# EAGLE board Copypaste (EAGLE 7.6.0), part 1 of 2
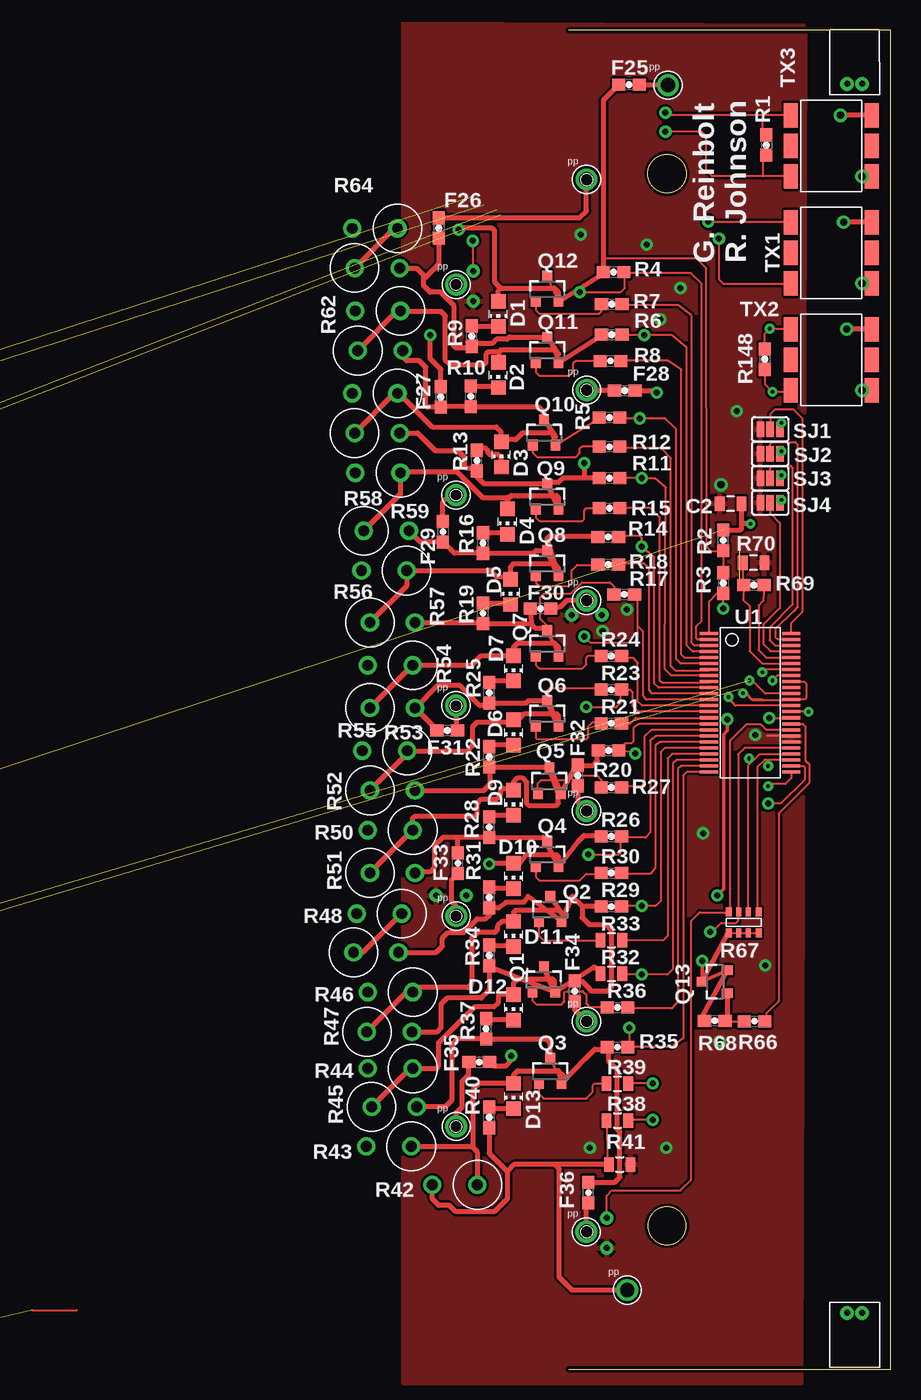
[diagram p3: board, top side]
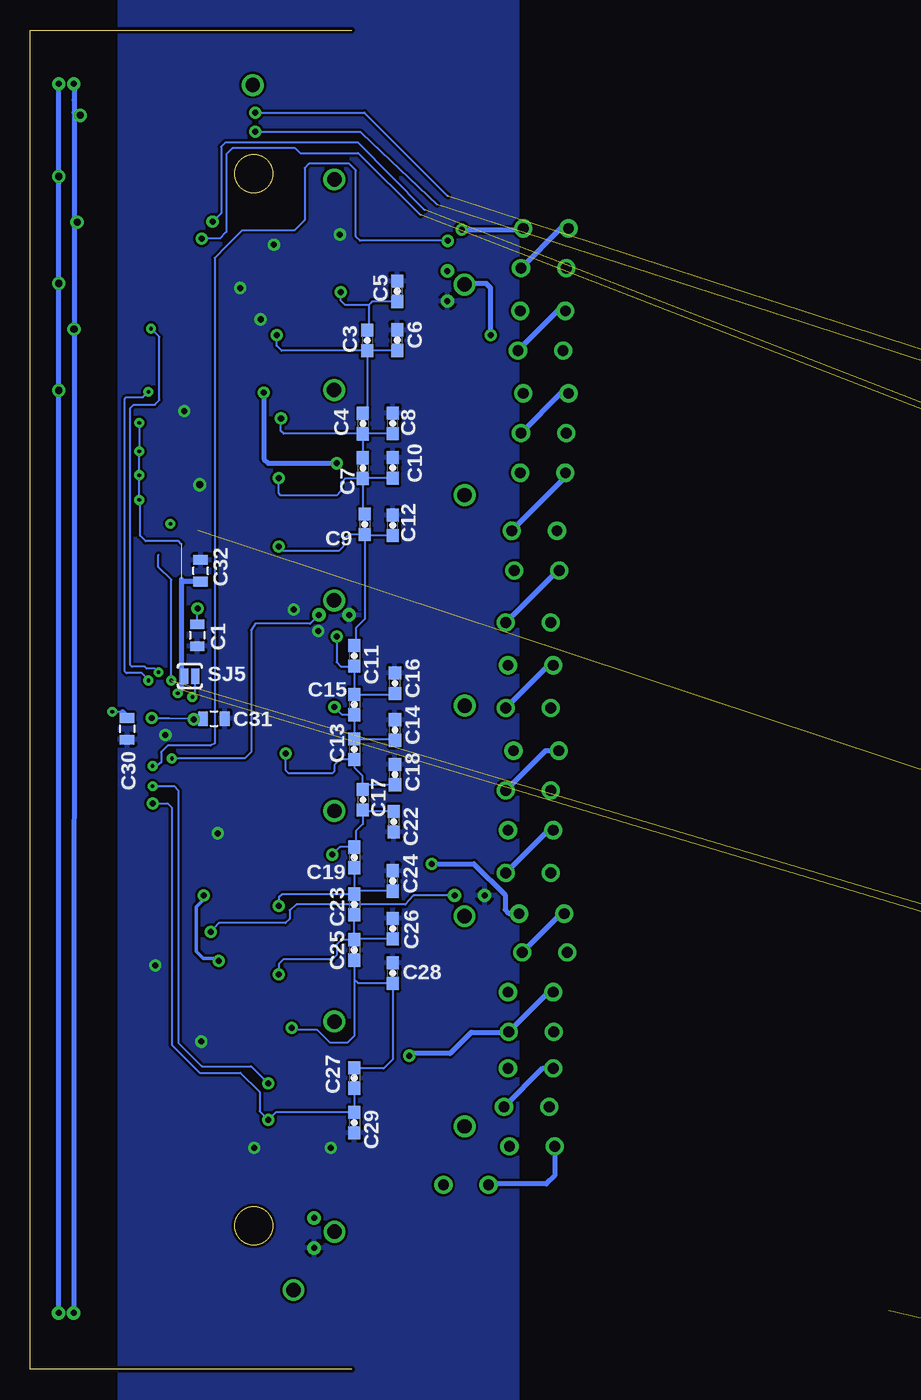
[diagram p4: board, bottom side, seen from below]

Size 26.75 x 111.35 mm. Coordinates in mm from the lower left corner, seen from the top.
Outline: 0,0 26.75,0 26.75,111.35 0,111.35
Outline: circle at 8.15,99.42 radius 1.6
Outline: circle at 8.15,11.94 radius 1.57
Copper layers (1*16): Top 0.035mm / dielectric 1.5mm / Bottom 0.035mm
Design rules "SparkFun *": minimum track width 7mil, minimum drill 12mil, track to track 8mil, track to pad 8mil, pad to pad 8mil, via to via 8mil, smd to smd 8mil, copper to edge 10mil, drill to drill 8mil, minimum pad ring 12mil, minimum via ring 10mil, stop-mask expansion 4mil, vias tented up to drill 25mil, thermal gap 10mil

## Footprints (pad centres in the part's own frame; a part is rotated, then mirrored left to right if it is on the bottom)
0805 = smd 0.8 x 1.2: 1 -0.9,0; 2 0.9,0
0603 = smd 1.1 x 1: 1 -0.85,0; 2 0.85,0
CHIP_LED0805 = smd 1.2 x 1.2: A 0,-1.05; C 0,1.05
DF13-2P = drill 0.5: 1 -0.625,0; 2 0.625,0
SOT23 = smd 0.8 x 0.9: 1 -0.95,-1; 2 0.95,-1; 3 0,1.1
RR02J16RTB = drill 0.9: P$1 -3.75,0; P$2 0,0
MNR14 = smd 0.5 x 0.75: 1 -1.25,-0.9; 4 1.25,-0.9; 5 1.25,0.85; 8 -1.25,0.85 | smd 0.4 x 0.75: 2 -0.4,-0.9; 3 0.4,-0.9; 6 0.4,0.85; 7 -0.4,0.85
NTC-NXRT15XH103FA5B = drill 0.5: P$1 0,0; P$2 2.5,0
PAD-JUMPER-3-NO_YES_SILK = smd 0.635 x 1.27: 1 -0.813,0; 2 0,0; 3 0.813,0
PAD-JUMPER-2-NO_YES_SILK = smd 0.635 x 1.27: 1 -0.45,0; 2 0.45,0
PE-68386NLT = smd 1.143 x 2.032: 1 -3.378,2.54; 2 -3.378,0; 3 -3.378,-2.54; 4 3.353,-2.54; 5 3.353,0; 6 3.353,2.54
SSOP-48 = smd 0.25 x 1.524: 1 -5.75,-3.421; 2 -5.25,-3.421; 3 -4.75,-3.421; 4 -4.25,-3.421; 5 -3.75,-3.421; 6 -3.25,-3.421; 7 -2.75,-3.421; 8 -2.25,-3.421; 9 -1.75,-3.421; 10 -1.25,-3.421; 11 -0.75,-3.421; 12 -0.25,-3.421; 13 0.25,-3.421; 14 0.75,-3.421; 15 1.25,-3.421; 16 1.75,-3.421; 17 2.25,-3.421; 18 2.75,-3.421; 19 3.25,-3.421; 20 3.75,-3.421; 21 4.25,-3.421; 22 4.75,-3.421; 23 5.25,-3.421; 24 5.75,-3.421; 25 5.75,3.421; 26 5.25,3.421; 27 4.75,3.421; 28 4.25,3.421; 29 3.75,3.421; 30 3.25,3.421; 31 2.75,3.421; 32 2.25,3.421; 33 1.75,3.421; 34 1.25,3.421; 35 0.75,3.421; 36 0.25,3.421; 37 -0.25,3.421; 38 -0.75,3.421; 39 -1.25,3.421; 40 -1.75,3.421; 41 -2.25,3.421; 42 -2.75,3.421; 43 -3.25,3.421; 44 -3.75,3.421; 45 -4.25,3.421; 46 -4.75,3.421; 47 -5.25,3.421; 48 -5.75,3.421
POGOPIN = drill 1.2: 1 0,0
SOT223 = smd 1.5 x 2: P$1 0,0; P$2 2.3,0; P$3 4.6,0 | smd 3.8 x 2: P$4 2.2,6.3

## Placement (x,y rotation side)
C1  0.1UF  [0805]  12.85,61.04 270 bottom
C2  0.1UF  [0805]  13.44,71.98 180 top
C3  10NF  [0603]  -1.27,85.55 270 bottom
C4  10NF  [0603]  -0.91,78.64 270 bottom
C5  DNP  [0603]  -3.76,89.64 90 bottom  (outside the outline)
C6  DNP  [0603]  -3.76,85.57 90 bottom  (outside the outline)
C7  10NF  [0603]  -0.91,74.93 270 bottom
C8  DNP  [0603]  -3.4,78.66 90 bottom  (outside the outline)
C9  10NF  [0603]  -1.07,70.26 270 bottom
C10  DNP  [0603]  -3.4,74.96 90 bottom  (outside the outline)
C11  10NF  [0603]  -0.2,59.33 270 bottom
C12  DNP  [0603]  -3.4,70.18 90 bottom  (outside the outline)
C13  10NF  [0603]  -0.2,51.56 270 bottom
C14  DNP  [0603]  -3.58,53.16 90 bottom  (outside the outline)
C15  10NF  [0603]  -0.2,55.27 270 bottom
C16  DNP  [0603]  -3.58,57.05 90 bottom  (outside the outline)
C17  10NF  [0603]  -0.91,47.37 270 bottom
C18  DNP  [0603]  -3.58,49.45 90 bottom  (outside the outline)
C19  10NF  [0603]  -0.2,42.57 270 bottom
C20  0.1UF  [0805]  -278.31,-0.51 0 top  (outside the outline)
C21  0.1UF  [0805]  -270.08,1.83 0 top  (outside the outline)
C22  DNP  [0603]  -3.48,45.54 270 bottom  (outside the outline)
C23  10NF  [0603]  -0.2,38.66 270 bottom
C24  DNP  [0603]  -3.4,40.61 90 bottom  (outside the outline)
C25  10NF  [0603]  -0.2,34.87 270 bottom
C26  DNP  [0603]  -3.4,36.65 90 bottom  (outside the outline)
C27  10NF  [0603]  -0.2,24.23 270 bottom
C28  DNP  [0603]  -3.4,32.94 90 bottom  (outside the outline)
C29  10NF  [0603]  -0.2,20.52 270 bottom
C30  1UF  [0805]  18.68,53.26 270 bottom
C31  1UF  [0805]  11.47,54.11 0 bottom
C32  1UF  [0805]  12.57,66.4 90 bottom
C33  10NF  [0603]  -294.23,20.62 270 bottom  (outside the outline)
C34  10NF  [0603]  -294.23,16.56 270 bottom  (outside the outline)
C37  10NF  [0603]  -294.23,12.5 270 bottom  (outside the outline)
C39  10NF  [0603]  -293.52,2.03 270 bottom  (outside the outline)
C41  10NF  [0603]  -293.52,-1.78 270 bottom  (outside the outline)
C43  10NF  [0603]  -293.34,-15.65 270 bottom  (outside the outline)
C45  10NF  [0603]  -293.52,-5.59 270 bottom  (outside the outline)
C47  10NF  [0603]  -293.34,-19.91 270 bottom  (outside the outline)
C49  10NF  [0603]  -293.34,-23.72 270 bottom  (outside the outline)
C51  10NF  [0603]  -293.34,-27.99 270 bottom  (outside the outline)
C53  10NF  [0603]  -293.34,-31.9 270 bottom  (outside the outline)
C55  10NF  [0603]  -293.88,-38.91 270 bottom  (outside the outline)
C57  10NF  [0603]  -293.79,-42.8 270 bottom  (outside the outline)
C58  1UF  [0805]  -268.78,-11.86 0 top  (outside the outline)
C59  1UF  [0805]  -277.75,-11.76 270 bottom  (outside the outline)
C60  1UF  [0805]  -268.43,-4.85 0 top  (outside the outline)
C61  1UF  [0805]  -268.44,-7.79 0 top  (outside the outline)
C63  0.1UF  [0805]  -332.71,18.52 90 top  (outside the outline)
C64  0.1UF  [0805]  -332.69,22.02 270 top  (outside the outline)
C65  10NF  [0603]  -355.09,20.14 270 bottom  (outside the outline)
C66  10NF  [0603]  -355.02,15.49 270 bottom  (outside the outline)
C69  10NF  [0603]  -354.89,11.25 270 bottom  (outside the outline)
C71  10NF  [0603]  -355.02,2.11 270 bottom  (outside the outline)
C73  10NF  [0603]  -355.14,-2.08 270 bottom  (outside the outline)
C75  10NF  [0603]  -355.27,-15.16 270 bottom  (outside the outline)
C77  10NF  [0603]  -355.27,-6.78 270 bottom  (outside the outline)
C79  10NF  [0603]  -355.37,-19.05 270 bottom  (outside the outline)
C81  10NF  [0603]  -355.37,-24.13 270 bottom  (outside the outline)
C83  10NF  [0603]  -355.37,-30.23 270 bottom  (outside the outline)
C85  10NF  [0603]  -355.37,-36.83 270 bottom  (outside the outline)
C87  10NF  [0603]  -355.22,-42.09 270 bottom  (outside the outline)
C89  10NF  [0603]  -342.16,-52.58 0 top  (outside the outline)
C90  1UF  [0805]  -323.98,-7.63 0 top  (outside the outline)
C91  1UF  [0805]  -324.13,-9.83 0 top  (outside the outline)
C92  1UF  [0805]  -321.72,-6.27 270 top  (outside the outline)
C93  1UF  [0805]  -331.83,26.78 180 top  (outside the outline)
D1  LED_RED  [CHIP_LED0805]  -5.87,87.76 180 top  (outside the outline)
D2  LED_RED  [CHIP_LED0805]  -5.87,82.68 180 top  (outside the outline)
D3  LED_RED  [CHIP_LED0805]  -5.61,76.07 180 top  (outside the outline)
D4  LED_RED  [CHIP_LED0805]  -5.11,70.48 180 top  (outside the outline)
D5  LED_RED  [CHIP_LED0805]  -4.85,64.64 180 top  (outside the outline)
D6  LED_RED  [CHIP_LED0805]  -4.6,52.96 180 top  (outside the outline)
D7  LED_RED  [CHIP_LED0805]  -4.6,58.29 180 top  (outside the outline)
D8  LED_RED  [CHIP_LED0805]  -304.39,30.05 180 top  (outside the outline)
D9  LED_RED  [CHIP_LED0805]  -4.6,47.12 180 top  (outside the outline)
D10  LED_RED  [CHIP_LED0805]  -4.6,41.02 180 top  (outside the outline)
D11  LED_RED  [CHIP_LED0805]  -4.6,36.2 180 top  (outside the outline)
D12  LED_RED  [CHIP_LED0805]  -4.6,30.1 180 top  (outside the outline)
D13  LED_RED  [CHIP_LED0805]  -4.6,22.73 180 top  (outside the outline)
D14  LED_RED  [CHIP_LED0805]  -304.32,23.37 180 top  (outside the outline)
D15  LED_RED  [CHIP_LED0805]  -304.06,13.72 180 top  (outside the outline)
D16  LED_RED  [CHIP_LED0805]  -304.06,9.65 180 top  (outside the outline)
D17  LED_RED  [CHIP_LED0805]  -304.06,3.3 180 top  (outside the outline)
D18  LED_RED  [CHIP_LED0805]  -303.81,-11.18 180 top  (outside the outline)
D19  LED_RED  [CHIP_LED0805]  -303.81,-4.06 180 top  (outside the outline)
D20  LED_RED  [CHIP_LED0805]  -302.79,-18.54 180 top  (outside the outline)
D21  LED_RED  [CHIP_LED0805]  -304.32,-25.4 180 top  (outside the outline)
D22  LED_RED  [CHIP_LED0805]  -304.32,-30.99 180 top  (outside the outline)
D23  LED_RED  [CHIP_LED0805]  -304.32,-39.88 180 top  (outside the outline)
D24  LED_RED  [CHIP_LED0805]  -304.32,-46.74 180 top  (outside the outline)
D25  LED_RED  [CHIP_LED0805]  -364.01,29.72 180 top  (outside the outline)
D26  LED_RED  [CHIP_LED0805]  -364.01,23.11 180 top  (outside the outline)
D27  LED_RED  [CHIP_LED0805]  -364.01,16.51 180 top  (outside the outline)
D28  LED_RED  [CHIP_LED0805]  -364.01,9.91 180 top  (outside the outline)
D29  LED_RED  [CHIP_LED0805]  -364.01,3.81 180 top  (outside the outline)
D30  LED_RED  [CHIP_LED0805]  -364.01,-9.4 180 top  (outside the outline)
D31  LED_RED  [CHIP_LED0805]  -364.01,-2.79 180 top  (outside the outline)
D32  LED_RED  [CHIP_LED0805]  -364.01,-16 180 top  (outside the outline)
D33  LED_RED  [CHIP_LED0805]  -364.01,-22.61 180 top  (outside the outline)
D34  LED_RED  [CHIP_LED0805]  -364.01,-29.21 180 top  (outside the outline)
D35  LED_RED  [CHIP_LED0805]  -364.01,-35.81 180 top  (outside the outline)
D36  LED_RED  [CHIP_LED0805]  -364.01,-42.42 180 top  (outside the outline)
F1  FUSE_750MA_63V_0603  [0603]  -344.25,41.86 180 top  (outside the outline)
F2  FUSE_750MA_63V_0603  [0603]  -355.88,27.18 180 top  (outside the outline)
F3  FUSE_750MA_63V_0603  [0603]  -355.88,20.57 180 top  (outside the outline)
F4  FUSE_750MA_63V_0603  [0603]  -355.88,13.46 180 top  (outside the outline)
F5  FUSE_750MA_63V_0603  [0603]  -355.88,7.87 180 top  (outside the outline)
F6  FUSE_750MA_63V_0603  [0603]  -355.88,0.76 180 top  (outside the outline)
F7  FUSE_750MA_63V_0603  [0603]  -355.88,-11.43 180 top  (outside the outline)
F8  FUSE_750MA_63V_0603  [0603]  -355.88,-18.03 180 top  (outside the outline)
F9  FUSE_750MA_63V_0603  [0603]  -355.88,-24.64 180 top  (outside the outline)
F10  FUSE_750MA_63V_0603  [0603]  -355.88,-31.24 180 top  (outside the outline)
F11  FUSE_750MA_63V_0603  [0603]  -355.88,-37.85 180 top  (outside the outline)
F12  FUSE_750MA_63V_0603  [0603]  -355.88,-44.45 180 top  (outside the outline)
F13  FUSE_750MA_63V_0603  [0603]  -297.97,40.89 270 top  (outside the outline)
F14  FUSE_750MA_63V_0603  [0603]  -301.52,34.34 0 top  (outside the outline)
F15  FUSE_750MA_63V_0603  [0603]  -300.36,21.06 180 top  (outside the outline)
F16  FUSE_750MA_63V_0603  [0603]  -301.85,18.01 0 top  (outside the outline)
F17  FUSE_750MA_63V_0603  [0603]  -298.15,7.24 180 top  (outside the outline)
F18  FUSE_750MA_63V_0603  [0603]  -301.4,-0.58 0 top  (outside the outline)
F19  FUSE_750MA_63V_0603  [0603]  -297.46,-8.89 180 top  (outside the outline)
F20  FUSE_750MA_63V_0603  [0603]  -302.77,-15.67 0 top  (outside the outline)
F21  FUSE_750MA_63V_0603  [0603]  -297.15,-27.61 180 top  (outside the outline)
F22  FUSE_750MA_63V_0603  [0603]  -301.93,-35.46 0 top  (outside the outline)
F23  FUSE_750MA_63V_0603  [0603]  -298.25,-42.55 180 top  (outside the outline)
F24  FUSE_750MA_63V_0603  [0603]  -300.51,-52.65 90 top  (outside the outline)
F25  FUSE_750MA_63V_0603  [0603]  5,106.81 180 top
F26  FUSE_750MA_63V_0603  [0603]  -10.82,94.89 270 top  (outside the outline)
F27  FUSE_750MA_63V_0603  [0603]  -10.64,80.85 270 top  (outside the outline)
F28  FUSE_750MA_63V_0603  [0603]  4.65,81.38 0 top
F29  FUSE_750MA_63V_0603  [0603]  -10.46,69.65 270 top  (outside the outline)
F30  FUSE_750MA_63V_0603  [0603]  -2.36,63.27 180 top
F31  FUSE_750MA_63V_0603  [0603]  -10.11,53.11 180 top  (outside the outline)
F32  FUSE_750MA_63V_0603  [0603]  0.74,49.38 90 top
F33  FUSE_750MA_63V_0603  [0603]  -9.22,42.09 90 top  (outside the outline)
F34  FUSE_750MA_63V_0603  [0603]  0.48,31.45 90 top
F35  FUSE_750MA_63V_0603  [0603]  -7.44,25.55 0 top  (outside the outline)
F36  FUSE_750MA_63V_0603  [0603]  1.63,14.71 90 top
J1  M2_DF13-2P  [DF13-2P]  23.75,4.7 180 top
J2  M2_DF13-2P  [DF13-2P]  23.74,106.88 0 top
Q1  BSS308PE  [SOT23]  -2.08,32.39 0 top
Q2  BSS308PE  [SOT23]  -1.55,38.23 0 top
Q3  BSS308PE  [SOT23]  -1.55,24.76 0 top
Q4  BSS308PE  [SOT23]  -1.8,42.8 0 top
Q5  BSS308PE  [SOT23]  -1.63,48.89 0 top
Q6  BSS308PE  [SOT23]  -1.8,54.48 0 top
Q7  BSS308PE  [SOT23]  -1.8,60.33 0 top
Q8  BSS308PE  [SOT23]  -1.8,66.98 0 top
Q9  BSS308PE  [SOT23]  -1.8,72.52 0 top
Q10  BSS308PE  [SOT23]  -2.06,77.85 0 top
Q11  BSS308PE  [SOT23]  -1.8,84.71 0 top
Q12  BSS308PE  [SOT23]  -1.8,89.79 0 top
Q13  BSS308PE  [SOT23]  12.16,32.23 90 top
Q14  BSS308PE  [SOT23]  -359.94,-34.8 90 top  (outside the outline)
Q15  BSS308PE  [SOT23]  -359.94,-28.19 90 top  (outside the outline)
Q16  BSS308PE  [SOT23]  -359.94,-41.4 90 top  (outside the outline)
Q17  BSS308PE  [SOT23]  -359.94,-21.59 90 top  (outside the outline)
Q18  BSS308PE  [SOT23]  -359.94,-14.99 90 top  (outside the outline)
Q19  BSS308PE  [SOT23]  -359.94,-8.38 90 top  (outside the outline)
Q20  BSS308PE  [SOT23]  -359.94,-1.78 90 top  (outside the outline)
Q21  BSS308PE  [SOT23]  -359.94,4.83 90 top  (outside the outline)
Q22  BSS308PE  [SOT23]  -359.94,10.92 90 top  (outside the outline)
Q23  BSS308PE  [SOT23]  -359.94,17.53 90 top  (outside the outline)
Q24  BSS308PE  [SOT23]  -359.94,24.13 90 top  (outside the outline)
Q25  BSS308PE  [SOT23]  -359.94,30.73 90 top  (outside the outline)
Q26  BSS308PE  [SOT23]  -330.46,-24.9 180 top  (outside the outline)
Q27  BSS308PE  [SOT23]  -299.24,-38.86 90 top  (outside the outline)
Q28  BSS308PE  [SOT23]  -299.39,-30.12 90 top  (outside the outline)
Q29  BSS308PE  [SOT23]  -299.36,-45.69 90 top  (outside the outline)
Q30  BSS308PE  [SOT23]  -299.75,-24.13 90 top  (outside the outline)
Q31  BSS308PE  [SOT23]  -299.49,-18.29 90 top  (outside the outline)
Q32  BSS308PE  [SOT23]  -299.49,-11.94 90 top  (outside the outline)
Q33  BSS308PE  [SOT23]  -299.19,-3.33 90 top  (outside the outline)
Q34  BSS308PE  [SOT23]  -299.49,4.32 90 top  (outside the outline)
Q35  BSS308PE  [SOT23]  -299.75,10.92 90 top  (outside the outline)
Q36  BSS308PE  [SOT23]  -300,15.75 90 top  (outside the outline)
Q37  BSS308PE  [SOT23]  -300.51,24.38 90 top  (outside the outline)
Q38  BSS308PE  [SOT23]  -300.51,31.24 90 top  (outside the outline)
Q39  BSS308PE  [SOT23]  -273.75,-31.66 90 top  (outside the outline)
R1  DNP  [0603]  16.41,101.79 270 top
R2  100  [0603]  12.83,68.94 90 top
R3  100  [0603]  12.83,65.38 270 top
R4  100  [0603]  3.71,91.24 0 top
R5  100  [0603]  3.38,79.15 0 top
R6  100  [0603]  3.56,86.03 0 top
R7  3.3K  [0603]  3.56,88.57 0 top
R8  3.3K  [0603]  3.45,83.85 0 top
R9  475  [0603]  -8.08,85.9 90 top  (outside the outline)
R10  475  [0603]  -8.15,80.9 90 top  (outside the outline)
R11  100  [0603]  3.38,74.12 0 top
R12  3.3K  [0603]  3.38,76.71 0 top
R13  475  [0603]  -7.65,75.56 90 top  (outside the outline)
R14  100  [0603]  3.28,69.22 0 top
R15  3.3K  [0603]  3.38,71.6 0 top
R16  475  [0603]  -7.14,68.71 90 top  (outside the outline)
R17  100  [0603]  4.6,64.44 0 top
R18  3.3K  [0603]  3.28,66.93 0 top
R19  475  [0603]  -7.14,62.87 90 top  (outside the outline)
R20  100  [0603]  3.3,51.46 0 top
R21  3.3K  [0603]  3.53,53.72 0 top
R22  475  [0603]  -6.63,50.93 90 top  (outside the outline)
R23  100  [0603]  3.53,56.52 0 top
R24  3.3K  [0603]  3.53,59.31 0 top
R25  475  [0603]  -6.63,56.26 90 top  (outside the outline)
R26  100  [0603]  3.53,44.32 0 top
R27  3.3K  [0603]  3.53,48.39 0 top
R28  475  [0603]  -6.63,45.08 90 top  (outside the outline)
R29  100  [0603]  3.53,38.48 0 top
R30  3.3K  [0603]  3.53,41.28 0 top
R31  475  [0603]  -6.63,39.24 90 top  (outside the outline)
R32  100  [0805]  3.53,32.89 0 top
R33  3.3K  [0805]  3.53,35.69 0 top
R34  475  [0603]  -6.63,34.42 90 top  (outside the outline)
R35  100  [0603]  4.04,26.8 0 top
R36  3.3K  [0603]  4.04,30.1 0 top
R37  475  [0603]  -6.88,28.32 90 top  (outside the outline)
R38  100  [0805]  4.04,20.7 0 top
R39  3.3K  [0805]  4.04,23.75 0 top
R40  475  [0603]  -6.63,20.96 90 top  (outside the outline)
R41  0  [0805]  4.22,17.04 0 top
R42  16  [RR02J16RTB]  -7.61,15.35 0 top  (outside the outline)
R43  16  [RR02J16RTB]  -13.1,18.55 0 top  (outside the outline)
R44  16  [RR02J16RTB]  -12.98,25.02 0 top  (outside the outline)
R45  16  [RR02J16RTB]  -16.39,21.83 180 top  (outside the outline)
R46  16  [RR02J16RTB]  -12.98,31.37 0 top  (outside the outline)
R47  16  [RR02J16RTB]  -16.79,28.07 180 top  (outside the outline)
R48  16  [RR02J16RTB]  -13.89,37.9 0 top  (outside the outline)
R49  16  [RR02J16RTB]  -17.91,34.67 180 top  (outside the outline)
R50  16  [RR02J16RTB]  -12.98,44.83 0 top  (outside the outline)
R51  16  [RR02J16RTB]  -16.54,41.28 180 top  (outside the outline)
R52  16  [RR02J16RTB]  -16.54,48.13 180 top  (outside the outline)
R53  16  [RR02J16RTB]  -13.44,51.44 0 top  (outside the outline)
R54  16  [RR02J16RTB]  -12.98,58.55 0 top  (outside the outline)
R55  16  [RR02J16RTB]  -16.54,54.99 180 top  (outside the outline)
R56  16  [RR02J16RTB]  -13.49,66.42 0 top  (outside the outline)
R57  16  [RR02J16RTB]  -16.54,62.1 180 top  (outside the outline)
R58  16  [RR02J16RTB]  -14,74.55 0 top  (outside the outline)
R59  16  [RR02J16RTB]  -17.04,69.72 180 top  (outside the outline)
R60  16  [RR02J16RTB]  -14.25,81.15 0 top  (outside the outline)
R61  16  [RR02J16RTB]  -17.81,77.85 180 top  (outside the outline)
R62  16  [RR02J16RTB]  -14,88.01 0 top  (outside the outline)
R63  16  [RR02J16RTB]  -17.55,84.71 180 top  (outside the outline)
R64  16  [RR02J16RTB]  -14.25,94.87 0 top  (outside the outline)
R65  16  [RR02J16RTB]  -17.81,91.57 180 top  (outside the outline)
R66  1K  [0603]  15.42,28.96 0 top
R67  10K  [MNR14]  14.52,37.13 180 top
R68  100K  [0603]  12.12,28.99 180 top
R69  1.2K  [0603]  15.37,65.21 0 top
R70  787  [0805]  15.35,67.07 180 top
R71  10K-NTC  [NTC-NXRT15XH103FA5B]  -7.94,88.82 90 top  (outside the outline)
R72  10K-NTC  [NTC-NXRT15XH103FA5B]  0.24,62.74 0 top
R73  10K-NTC  [NTC-NXRT15XH103FA5B]  -11.03,39.4 0 top  (outside the outline)
R74  100  [0603]  -274.5,1.91 0 top  (outside the outline)
R75  100  [0805]  -278.31,1.91 180 top  (outside the outline)
R76  100  [0805]  -296.44,32.26 0 top  (outside the outline)
R77  100  [0603]  -296.19,16.51 0 top  (outside the outline)
R78  100  [0603]  -295.94,23.11 0 top  (outside the outline)
R79  3.3K  [0805]  -296.44,30.23 0 top  (outside the outline)
R80  3.3K  [0603]  -295.94,21.59 0 top  (outside the outline)
R81  475  [0603]  -306.4,28.19 90 top  (outside the outline)
R82  475  [0603]  -306.35,21.34 90 top  (outside the outline)
R83  100  [0603]  -295.94,12.19 0 top  (outside the outline)
R84  3.3K  [0805]  -296.19,14.48 0 top  (outside the outline)
R85  475  [0603]  -306.1,13.21 90 top  (outside the outline)
R86  100  [0603]  -295.43,5.33 0 top  (outside the outline)
R87  3.3K  [0603]  -295.94,10.41 0 top  (outside the outline)
R88  475  [0603]  -306.1,7.87 90 top  (outside the outline)
R89  100  [0603]  -295.17,-2.54 0 top  (outside the outline)
R90  3.3K  [0603]  -295.43,3.3 0 top  (outside the outline)
R91  475  [0603]  -306.35,3.05 90 top  (outside the outline)
R92  100  [0603]  -295.68,-17.27 0 top  (outside the outline)
R93  3.3K  [0603]  -295.43,-13.21 0 top  (outside the outline)
R94  475  [0603]  -306.3,-13.23 90 top  (outside the outline)
R95  100  [0603]  -295.43,-11.43 0 top  (outside the outline)
R96  3.3K  [0603]  -295.17,-4.32 0 top  (outside the outline)
R97  475  [0603]  -306.12,-6.2 90 top  (outside the outline)
R98  100  [0603]  -295.94,-22.86 0 top  (outside the outline)
R99  3.3K  [0603]  -295.68,-19.05 0 top  (outside the outline)
R100  475  [0603]  -306.6,-20.83 90 top  (outside the outline)
R101  100  [0603]  -295.66,-29.13 0 top  (outside the outline)
R102  3.3K  [0603]  -295.94,-24.89 0 top  (outside the outline)
R103  475  [0603]  -306.5,-27.38 90 top  (outside the outline)
R104  100  [0805]  -295.45,-37.62 0 top  (outside the outline)
R105  3.3K  [0805]  -295.63,-31.29 0 top  (outside the outline)
R106  475  [0603]  -306.27,-32.92 90 top  (outside the outline)
R107  100  [0603]  -294.28,-46.46 0 top  (outside the outline)
R108  3.3K  [0603]  -295.35,-40.13 0 top  (outside the outline)
R109  475  [0603]  -306.48,-41.76 90 top  (outside the outline)
R110  100  [0603]  -294.59,-53.16 0 top  (outside the outline)
R111  3.3K  [0603]  -294.26,-48.23 0 top  (outside the outline)
R112  475  [0603]  -306.4,-48.62 90 top  (outside the outline)
R113  0  [0603]  -294.63,-54.87 0 top  (outside the outline)
R114  16  [RR02J16RTB]  -312.95,-49.53 180 top  (outside the outline)
R115  16  [RR02J16RTB]  -309.14,-45.97 0 top  (outside the outline)
R116  16  [RR02J16RTB]  -309.14,-38.86 0 top  (outside the outline)
R117  16  [RR02J16RTB]  -312.95,-42.42 180 top  (outside the outline)
R118  16  [RR02J16RTB]  -309.14,-31.75 0 top  (outside the outline)
R119  16  [RR02J16RTB]  -312.95,-35.31 180 top  (outside the outline)
R120  16  [RR02J16RTB]  -309.14,-24.64 0 top  (outside the outline)
R121  16  [RR02J16RTB]  -312.95,-28.19 180 top  (outside the outline)
R122  16  [RR02J16RTB]  -309.07,-17.73 0 top  (outside the outline)
R123  16  [RR02J16RTB]  -312.95,-21.34 180 top  (outside the outline)
R124  16  [RR02J16RTB]  -312.95,-14.22 180 top  (outside the outline)
R125  16  [RR02J16RTB]  -309.14,-10.69 0 top  (outside the outline)
R126  16  [RR02J16RTB]  -309.14,-3.56 0 top  (outside the outline)
R127  16  [RR02J16RTB]  -312.95,-7.11 180 top  (outside the outline)
R128  16  [RR02J16RTB]  -309.14,3.56 0 top  (outside the outline)
R129  16  [RR02J16RTB]  -312.95,0 180 top  (outside the outline)
R130  16  [RR02J16RTB]  -309.12,10.24 0 top  (outside the outline)
R131  16  [RR02J16RTB]  -312.95,6.86 180 top  (outside the outline)
R132  16  [RR02J16RTB]  -309.14,17.02 0 top  (outside the outline)
R133  16  [RR02J16RTB]  -312.95,13.72 180 top  (outside the outline)
R134  16  [RR02J16RTB]  -309.14,23.88 0 top  (outside the outline)
R135  16  [RR02J16RTB]  -312.95,20.32 180 top  (outside the outline)
R136  16  [RR02J16RTB]  -309.14,30.48 0 top  (outside the outline)
R137  16  [RR02J16RTB]  -312.95,27.18 180 top  (outside the outline)
R138  1K  [0603]  -270.69,-31.82 90 top  (outside the outline)
R139  10K  [MNR14]  -277.51,-31.13 180 top  (outside the outline)
R140  100K  [0603]  -274.01,-35.15 180 top  (outside the outline)
R141  1.2K  [0603]  -275.46,-5.66 90 bottom  (outside the outline)
R142  787  [0805]  -277.45,-5.7 270 bottom  (outside the outline)
R143  10K-NTC  [NTC-NXRT15XH103FA5B]  -292.48,24.41 90 top  (outside the outline)
R144  10K-NTC  [NTC-NXRT15XH103FA5B]  -306.61,-1.97 90 top  (outside the outline)
R145  10K-NTC  [NTC-NXRT15XH103FA5B]  -292.62,-28.16 90 top  (outside the outline)
R146  10K-NTC  [NTC-NXRT15XH103FA5B]  -303.44,-54.73 90 top  (outside the outline)
R147  10K-NTC  [NTC-NXRT15XH103FA5B]  3.14,10.1 90 top
R148  DNP  [0603]  16.28,83.99 270 top
R149  100  [0603]  -336.6,19.46 90 top  (outside the outline)
R150  100  [0603]  -336.65,15.93 270 top  (outside the outline)
R151  100  [0603]  -355.88,31.75 180 top  (outside the outline)
R152  100  [0603]  -355.88,18.54 0 top  (outside the outline)
R153  100  [0805]  -355.88,25.15 0 top  (outside the outline)
R154  3.3K  [0603]  -355.88,29.72 0 top  (outside the outline)
R155  3.3K  [0805]  -355.88,23.11 0 top  (outside the outline)
R156  475  [0603]  -366.55,28.19 90 top  (outside the outline)
R157  475  [0603]  -366.62,21.26 90 top  (outside the outline)
R158  100  [0603]  -355.88,11.94 0 top  (outside the outline)
R159  3.3K  [0603]  -355.88,16.51 0 top  (outside the outline)
R160  475  [0603]  -366.55,14.48 90 top  (outside the outline)
R161  100  [0603]  -355.88,5.84 0 top  (outside the outline)
R162  3.3K  [0805]  -355.88,9.91 0 top  (outside the outline)
R163  475  [0603]  -366.55,7.87 90 top  (outside the outline)
R164  100  [0603]  -355.88,-0.76 0 top  (outside the outline)
R165  3.3K  [0603]  -355.88,3.81 0 top  (outside the outline)
R166  475  [0603]  -366.55,1.78 90 top  (outside the outline)
R167  100  [0603]  -355.88,-13.97 0 top  (outside the outline)
R168  3.3K  [0603]  -355.88,-9.4 0 top  (outside the outline)
R169  475  [0603]  -366.55,-11.43 90 top  (outside the outline)
R170  100  [0603]  -355.88,-7.37 0 top  (outside the outline)
R171  3.3K  [0603]  -355.88,-2.79 0 top  (outside the outline)
R172  475  [0603]  -366.55,-4.83 90 top  (outside the outline)
R173  100  [0603]  -355.88,-20.57 0 top  (outside the outline)
R174  3.3K  [0603]  -355.88,-16 0 top  (outside the outline)
R175  475  [0603]  -366.55,-18.03 90 top  (outside the outline)
R176  100  [0603]  -355.88,-27.18 0 top  (outside the outline)
R177  3.3K  [0805]  -355.88,-22.61 0 top  (outside the outline)
R178  475  [0603]  -366.55,-24.64 90 top  (outside the outline)
R179  100  [0603]  -355.85,-34.01 0 top  (outside the outline)
R180  3.3K  [0603]  -355.88,-29.21 0 top  (outside the outline)
R181  475  [0603]  -366.55,-31.24 90 top  (outside the outline)
R182  100  [0805]  -355.88,-40.39 0 top  (outside the outline)
R183  3.3K  [0805]  -355.88,-35.81 0 top  (outside the outline)
R184  475  [0603]  -366.55,-37.85 90 top  (outside the outline)
R185  100  [0603]  -343.18,-55.63 90 top  (outside the outline)
R186  3.3K  [0805]  -355.88,-42.42 0 top  (outside the outline)
R187  475  [0603]  -366.55,-44.45 90 top  (outside the outline)
R188  0  [0603]  -341.47,-55.61 90 top  (outside the outline)
R189  16  [RR02J16RTB]  -373.41,-45.47 180 top  (outside the outline)
R190  16  [RR02J16RTB]  -369.6,-42.16 0 top  (outside the outline)
R191  16  [RR02J16RTB]  -369.6,-35.56 0 top  (outside the outline)
R192  16  [RR02J16RTB]  -373.41,-38.86 180 top  (outside the outline)
R193  16  [RR02J16RTB]  -369.6,-28.96 0 top  (outside the outline)
R194  16  [RR02J16RTB]  -373.41,-32.26 180 top  (outside the outline)
R195  16  [RR02J16RTB]  -369.6,-22.35 0 top  (outside the outline)
R196  16  [RR02J16RTB]  -373.41,-25.65 180 top  (outside the outline)
R197  16  [RR02J16RTB]  -369.6,-15.75 0 top  (outside the outline)
R198  16  [RR02J16RTB]  -373.41,-19.05 180 top  (outside the outline)
R199  16  [RR02J16RTB]  -373.41,-12.45 180 top  (outside the outline)
R200  16  [RR02J16RTB]  -369.6,-9.14 0 top  (outside the outline)
R201  16  [RR02J16RTB]  -369.6,-2.54 0 top  (outside the outline)
R202  16  [RR02J16RTB]  -373.41,-5.84 180 top  (outside the outline)
R203  16  [RR02J16RTB]  -369.6,4.06 0 top  (outside the outline)
R204  16  [RR02J16RTB]  -373.41,0.76 180 top  (outside the outline)
R205  16  [RR02J16RTB]  -369.6,10.67 0 top  (outside the outline)
R206  16  [RR02J16RTB]  -373.41,7.37 180 top  (outside the outline)
R207  16  [RR02J16RTB]  -369.6,17.27 0 top  (outside the outline)
R208  16  [RR02J16RTB]  -373.41,13.97 180 top  (outside the outline)
R209  16  [RR02J16RTB]  -369.6,23.88 0 top  (outside the outline)
R210  16  [RR02J16RTB]  -373.41,20.57 180 top  (outside the outline)
R211  16  [RR02J16RTB]  -373.41,27.18 180 top  (outside the outline)
R212  16  [RR02J16RTB]  -369.6,30.48 0 top  (outside the outline)
R213  1K  [0603]  -327.74,-20.47 90 top  (outside the outline)
R214  10K  [MNR14]  -329.97,-30.4 90 top  (outside the outline)
R215  100K  [0603]  -327.74,-24.66 270 top  (outside the outline)
R216  1.2K  [0603]  -321.94,-2.86 180 top  (outside the outline)
R217  787  [0805]  -327.09,-4.61 90 top  (outside the outline)
R218  10K-NTC  [NTC-NXRT15XH103FA5B]  -348.53,-54.62 90 top  (outside the outline)
R219  10K-NTC  [NTC-NXRT15XH103FA5B]  -337.94,-28.13 90 top  (outside the outline)
R220  10K-NTC  [NTC-NXRT15XH103FA5B]  -348.89,-2.05 90 top  (outside the outline)
R221  10K-NTC  [NTC-NXRT15XH103FA5B]  -338.03,26.84 270 top  (outside the outline)
SJ1  [PAD-JUMPER-3-NO_YES_SILK]  16.73,78.16 180 top
SJ2  [PAD-JUMPER-3-NO_YES_SILK]  16.73,76.13 180 top
SJ3  [PAD-JUMPER-3-NO_YES_SILK]  16.73,74.09 180 top
SJ4  [PAD-JUMPER-3-NO_YES_SILK]  16.73,72.06 180 top
SJ5  [PAD-JUMPER-2-NO_YES_SILK]  13.47,57.64 180 bottom
SJ6  [PAD-JUMPER-3-NO_YES_SILK]  -274.08,7.31 180 top  (outside the outline)
SJ7  [PAD-JUMPER-3-NO_YES_SILK]  -274.16,10 180 top  (outside the outline)
SJ8  [PAD-JUMPER-3-NO_YES_SILK]  -274.13,12.65 180 top  (outside the outline)
SJ9  [PAD-JUMPER-3-NO_YES_SILK]  -274.13,15.3 180 top  (outside the outline)
SJ10  [PAD-JUMPER-2-NO_YES_SILK]  -269.29,-9.79 90 top  (outside the outline)
SJ11  [PAD-JUMPER-3-NO_YES_SILK]  -328.7,28.94 0 top  (outside the outline)
SJ12  [PAD-JUMPER-3-NO_YES_SILK]  -328.76,31.66 0 top  (outside the outline)
SJ13  [PAD-JUMPER-3-NO_YES_SILK]  -328.83,34.73 0 top  (outside the outline)
SJ14  [PAD-JUMPER-3-NO_YES_SILK]  -328.89,37.81 0 top  (outside the outline)
SJ15  [PAD-JUMPER-2-NO_YES_SILK]  -323.73,-5.61 90 top  (outside the outline)
TX1  PE-68386NLT  [PE-68386NLT]  21.82,92.84 0 top
TX2  PE-68386NLT  [PE-68386NLT]  21.82,83.95 0 top
TX3  PE-68386NLT  [PE-68386NLT]  21.82,101.73 0 top
U1  LTC6804-2  [SSOP-48]  15.07,55.43 270 top
U2  LTC6804-2  [SSOP-48]  -275.88,-9.82 270 top  (outside the outline)
U3  LTC6804-2  [SSOP-48]  -333.02,-9.4 270 top  (outside the outline)
U$1  POGOPIN  [POGOPIN]  4.85,6.6 0 top
U$2  POGOPIN  [POGOPIN]  1.45,11.45 0 top
U$3  POGOPIN  [POGOPIN]  -9.37,20.21 0 top  (outside the outline)
U$4  POGOPIN  [POGOPIN]  1.46,28.93 0 top
U$5  POGOPIN  [POGOPIN]  -9.36,37.69 0 top  (outside the outline)
U$6  POGOPIN  [POGOPIN]  1.46,46.43 0 top
U$7  POGOPIN  [POGOPIN]  -9.38,55.19 0 top  (outside the outline)
U$8  POGOPIN  [POGOPIN]  1.47,63.93 0 top
U$9  POGOPIN  [POGOPIN]  -9.37,72.69 0 top  (outside the outline)
U$10  POGOPIN  [POGOPIN]  1.48,81.43 0 top
U$11  POGOPIN  [POGOPIN]  -9.37,90.19 0 top  (outside the outline)
U$12  POGOPIN  [POGOPIN]  1.46,98.94 0 top
U$13  POGOPIN  [POGOPIN]  8.24,106.78 0 top
U$14  POGOPIN  [POGOPIN]  -340.82,-60.66 0 top  (outside the outline)
U$15  POGOPIN  [POGOPIN]  -350.42,-53.14 0 top  (outside the outline)
U$16  POGOPIN  [POGOPIN]  -339.54,-44.38 0 top  (outside the outline)
U$17  POGOPIN  [POGOPIN]  -350.41,-35.64 0 top  (outside the outline)
U$18  POGOPIN  [POGOPIN]  -339.56,-26.92 0 top  (outside the outline)
U$19  POGOPIN  [POGOPIN]  -350.43,-18.15 0 top  (outside the outline)
U$20  POGOPIN  [POGOPIN]  -339.55,-9.42 0 top  (outside the outline)
U$21  POGOPIN  [POGOPIN]  -350.42,-0.68 0 top  (outside the outline)
U$22  POGOPIN  [POGOPIN]  -339.57,8.11 0 top  (outside the outline)
U$23  POGOPIN  [POGOPIN]  -350.42,16.85 0 top  (outside the outline)
U$24  POGOPIN  [POGOPIN]  -339.57,25.6 0 top  (outside the outline)
U$25  POGOPIN  [POGOPIN]  -350.41,34.35 0 top  (outside the outline)
U$26  POGOPIN  [POGOPIN]  -340.83,41.84 0 top  (outside the outline)
U$27  LOGO16-2-L  [2016-2-LOGO-L]  -381.69,-45.49 90 top  (outside the outline)
U$28  NSV1C201MZ4T1G  [SOT223]  -327.94,14.99 0 top  (outside the outline)
U$29  NSV1C201MZ4T1G  [SOT223]  -399.57,-68.33 0 top  (outside the outline)
U$30  NSV1C201MZ4T1G  [SOT223]  -407.19,-68.33 0 top  (outside the outline)
U$40  POGOPIN  [POGOPIN]  -295.42,-60.65 0 top  (outside the outline)
U$41  POGOPIN  [POGOPIN]  -305.02,-53.15 0 top  (outside the outline)
U$42  POGOPIN  [POGOPIN]  -294.17,-44.39 0 top  (outside the outline)
U$43  POGOPIN  [POGOPIN]  -305.01,-35.65 0 top  (outside the outline)
U$44  POGOPIN  [POGOPIN]  -294.19,-26.89 0 top  (outside the outline)
U$45  POGOPIN  [POGOPIN]  -305,-18.17 0 top  (outside the outline)
U$46  POGOPIN  [POGOPIN]  -294.18,-9.4 0 top  (outside the outline)
U$47  POGOPIN  [POGOPIN]  -304.99,-0.66 0 top  (outside the outline)
U$48  POGOPIN  [POGOPIN]  -294.17,8.12 0 top  (outside the outline)
U$49  POGOPIN  [POGOPIN]  -305.01,16.84 0 top  (outside the outline)
U$50  POGOPIN  [POGOPIN]  -294.19,25.6 0 top  (outside the outline)
U$51  POGOPIN  [POGOPIN]  -305.01,34.36 0 top  (outside the outline)
U$52  POGOPIN  [POGOPIN]  -295.43,41.83 0 top  (outside the outline)